# EasyEDA Pro project ca_car.eprj, board ca_pcb (continued)
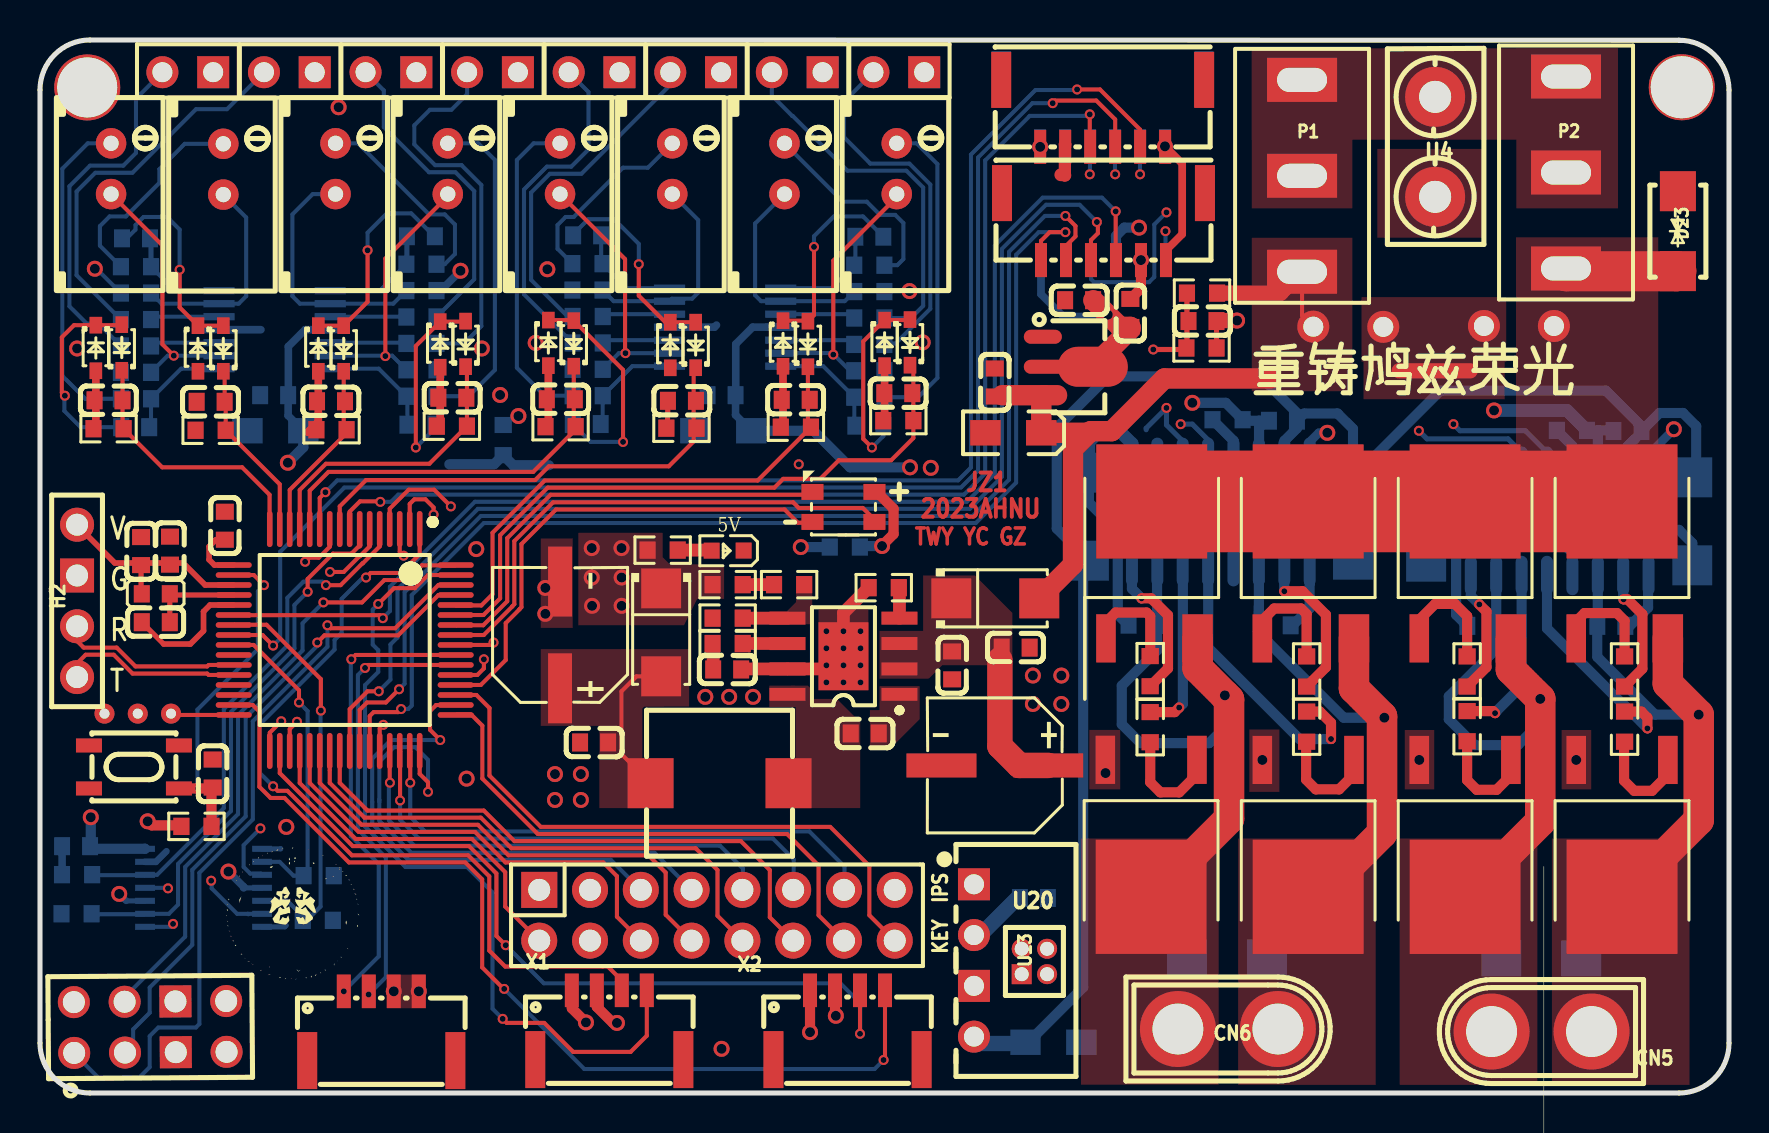
[diagram p0: board, top side]
## Copper pours and planes (outline as drawn; the poured copper is in the pictures) (continued)
GND on 信号: 67.18,46.99 72.48,46.99 72.48,42.44 67.18,42.44
GND on 信号: 45.54,52.65 45.54,32 0,32 0,0 84.47,0 84.47,52.66 45.55,52.66
GND on 地2: 45.54,52.65 45.54,32 0,32 0,0 84.47,0 84.47,52.66 45.55,52.66
GND on 地2: 67.03,46.96 72.39,46.96 72.39,42.42 67.03,42.42
VCC on Top Layer: 60.6,42.77 65.63,42.77 65.63,35.1 60.6,35.1
VCCBAT on Top Layer: 60.6,52.2 65.63,52.2 65.63,44.25 60.6,44.25
VCCBAT on Top Layer: 73.84,52.25 78.92,52.25 78.92,44.25 73.84,44.25
VCCBAT on Top Layer: 60.6,52.25 78.92,52.25 78.92,47.68 60.6,47.68
VCCBAT on Bottom Layer: 60.6,52.2 65.63,52.2 65.63,44.25 60.6,44.25
VCCBAT on Bottom Layer: 73.84,52.25 78.92,52.25 78.92,44.25 73.84,44.25
VCCBAT on Bottom Layer: 60.6,52.25 78.92,52.25 78.92,47.68 60.6,47.68
VCCBAT on 地1: 60.6,52.25 78.92,52.25 78.92,47.68 60.6,47.68
VCCBAT on 地1: 60.6,52.2 65.63,52.2 65.63,44.25 60.6,44.25
VCCBAT on 地1: 73.84,52.25 78.92,52.25 78.92,44.25 73.84,44.25
VCCBAT on 信号: 60.6,52.2 65.63,52.2 65.63,44.25 60.6,44.25
VCCBAT on 信号: 60.6,52.2 65.63,52.2 65.63,44.25 60.6,44.25
VCCBAT on 信号: 60.6,52.2 65.63,52.2 65.63,44.25 60.6,44.25
VCCBAT on 信号: 60.6,52.25 78.92,52.25 78.92,47.68 60.6,47.68
VCCBAT on 信号: 60.6,52.25 78.92,52.25 78.92,47.68 60.6,47.68
VCCBAT on 信号: 73.84,52.25 78.92,52.25 78.92,44.25 73.84,44.25
VCCBAT on 信号: 60.6,52.25 78.92,52.25 78.92,47.68 60.6,47.68
VCCBAT on 信号: 73.84,52.25 78.92,52.25 78.92,44.25 73.84,44.25
VCCBAT on 信号: 73.84,52.25 78.92,52.25 78.92,44.25 73.84,44.25
VCCBAT on 电源: 60.6,52.22 78.92,52.22 78.92,47.65 60.6,47.65
VCCBAT on 电源: 60.6,52.17 65.63,52.17 65.63,44.22 60.6,44.22
VCCBAT on 电源: 73.84,52.22 78.92,52.22 78.92,44.22 73.84,44.22
VCCBAT on 地2: 60.6,52.2 65.63,52.2 65.63,44.25 60.6,44.25
VCCBAT on 地2: 73.84,52.25 78.92,52.25 78.92,44.25 73.84,44.25
VCCBAT on 地2: 60.6,52.25 78.92,52.25 78.92,47.68 60.6,47.68
VCCMOTOR on Top Layer: 73.82,42.8 80.93,42.8 80.93,31.55 73.82,31.55
MOTOR1+ on Top Layer: 68,12.73 74.89,12.73 74.89,0.41 68,0.41
MOTOR1+ on Bottom Layer: 70.61,8.05 74.59,8.05 74.59,0.94 70.61,0.94
MOTOR1- on Top Layer: 75.62,12.73 82.5,12.73 82.5,0.41 75.62,0.41
MOTOR1- on Bottom Layer: 75.61,8.05 79.59,8.05 79.59,0.94 75.61,0.94
MOTOR2+ on Top Layer: 52.06,12.73 58.95,12.73 58.95,0.41 52.06,0.41
MOTOR2+ on Bottom Layer: 54.92,8.18 58.91,8.18 58.91,1.07 54.92,1.07
MOTOR2- on Top Layer: 59.92,12.73 66.8,12.73 66.8,0.41 59.92,0.41
MOTOR2- on Bottom Layer: 59.92,8.18 63.91,8.18 63.91,1.07 59.92,1.07
$1N458057 on Top Layer: 41.99,25.88 48.63,25.88 48.63,20.73 41.99,20.73
$1N475660 on Top Layer: 41.5,20.35 43.99,20.35 43.99,17.32 41.5,17.32
$1N476009 on Top Layer: 36.47,20.37 38.16,20.37 38.16,19.14 36.47,19.14
$1N476009 on Top Layer: 37.57,20.37 38.68,20.37 38.68,19.39 37.57,19.39
$1N476009 on Top Layer: 37.8,19.71 41.02,19.71 41.02,14.25 37.8,14.25
$1N478879 on Top Layer: 25.04,22.2 29.41,22.2 29.41,14.25 25.04,14.25
$1N478879 on Top Layer: 28.55,22.2 32.46,22.2 32.46,14.96 28.55,14.96
$1N487218 on Top Layer: 36.7,25.78 38.62,25.78 38.62,23.44 36.7,23.44

Small or netless copper shapes (teardrops, artwork), in the pictures only: 1 on Bottom Layer

## Text on the board
Top Layer: TWY YC GZ | 2023AHNU | JZ1
Top Solder Mask Layer: TWY YC GZ | 2023AHNU | JZ1
Top Silkscreen Layer: IPS | KEY | V | G | R | T | 5V | 重铸鸠兹荣光
